# EasyEDA Pro project ProPrj_Starcat_FOC双路矢量控制器_2024-11-11.epro, board PCB6_2
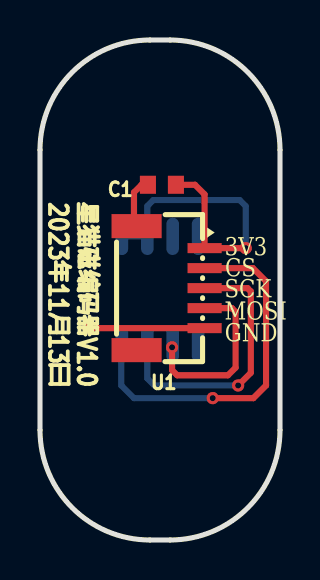
[diagram p5: board, top side]
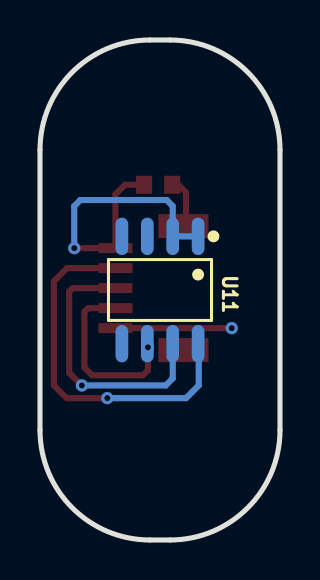
[diagram p6: board, bottom side, seen from below]

Outline 12 x 25 mm; copper layers: Top Layer, Bottom Layer. Coordinates in mm from the lower left corner of the outline.
Outline path: 0,19.5 0,5.5 arc(1.61,1.61) 5.5,0 6.5,0 arc(10.39,1.61) 12,5.5 12,19.5 arc(10.39,23.39) 6.5,25 5.5,25 arc(1.61,23.39) 0,19.5
Stack: Top Layer 0.035mm / Dielectric1 1.51mm FR4 er 4.5 / Bottom Layer 0.035mm

## Design rules (mm)
template: JLCPCB Capability(Two Layers Board)
spacing copperThickness1oz (default): track to track 0.102, other pairs 0.152 to 0.3
spacing copperThickness2oz: track to track 0.203, other pairs 0.152 to 0.3
track width copperThickness1oz (default): min 0.127, default 0.254, max 2.54
track width copperThickness2oz: min 0.203, default 0.254, max 2.54
differential pair differentialPair (default): width min 0.127, default 0.254, max 2.54; gap min 0.152, default 0.152
via viaSize (default): diameter min 0.5, default 0.61, max 10; hole min 0.3, default 0.305, max 6.3

## Placement (name value [footprint] x y rotation side)
C1  100nF  [C0603]  6.1 17.76 180 top
U1  ZX-SH1.0-5PWT  [CONN-SMD_5P-P1.00_MEGASTAR_ZX-SH1.0-5PWT]  6.53 12.59 270 top
U11  MT6701CT-STD-R  [SOP-8_L4.9-W3.9-P1.27-LS6.0-BL]  6 12.5 0 bottom

## Footprints (pads in the part's own frame, mm; a bottom-side part is the same pattern mirrored in y, then rotated)
C0603
  rect 0.8x0.9 smd: 1(-0.7,0) 2(0.7,0)
CONN-SMD_5P-P1.00_MEGASTAR_ZX-SH1.0-5PWT
  rect 0.5x1.7 smd: 1(-2,1.7) 2(-1,1.7) 3(0,1.7) 4(1,1.7) 5(2,1.7)
  rect 1.2x2.5 smd: 6(3.1,-1.7) 7(-3.1,-1.7)
SOP-8_L4.9-W3.9-P1.27-LS6.0-BL
  oval 0.63x1.865 smd: 1(-1.905,-2.683) 2(-0.635,-2.683) 3(0.635,-2.683) 4(1.905,-2.683) 5(1.905,2.683) 6(0.635,2.683) 7(-0.635,2.683) 8(-1.905,2.683)

## Nets
As in the schematic.

Pads without a net: U11 3 5

## Via types
v1: diameter 0.61, hole 0.305, Top Layer to Bottom Layer, 5 vias

## Routing (per net, layer and track width the routed paths; a pad name or vN(x,y) marks a point on that pad's centre or on a via; arc(x,y) is an arc through that point)
+3V3: length 16.4
  Top Layer w0.305: v1(10.29,14.59) 8.23,14.59 8.23,17.28 7.75,17.76 C1.1
  Bottom Layer w0.305: U11.1 U11.2 5.37,16.69 5.67,17 9.98,17 10.29,16.69 v1(10.29,14.59) 10.29,14.59
GND: length 8.5
  Top Layer w0.305: C1.2 5.08,17.76 4.7,17.38 4.7,15.82 U1.7 ; 8.23,10.59 v1(2.41,10.59)
  Bottom Layer w0.305: v1(2.41,10.59) 2.41,10.52
MT_CS: length 18.4
  Top Layer w0.305: 8.23,13.59 10.65,13.59 11.3,12.94 11.3,7.73 10.67,7.09 v1(8.64,7.09)
  Bottom Layer w0.305: U11.8 4.06,9.79 4.06,7.73 4.7,7.09 v1(8.64,7.09)
MT_MOSI: length 9
  Top Layer w0.305: v1(6.6,9.63) 6.6,8.49 6.86,8.24 9.4,8.24 9.78,8.62 9.78,11.41 9.6,11.59 8.23,11.59
MT_SCK: length 13.8
  Top Layer w0.305: 8.23,12.59 10.38,12.59 10.54,12.43 10.54,8.36 v1(9.91,7.73)
  Bottom Layer w0.305: v1(9.91,7.73) 5.72,7.73 5.37,8.08 U11.7

## Copper pours and planes (outline as drawn; the poured copper is in the pictures)
GND on Top Layer: -4.22,29.09 16.28,29.09 16.28,-1.91 -4.22,-1.91
GND on Bottom Layer: -3.44,25.53 13.39,25.53 13.39,-3.48 -3.44,-3.48

## Text on the board
Top Silkscreen Layer: 星猫磁编码器V1.0 / 2023年11月13日 | SCK | MOSI | 3V3 | GND | CS
